# Altium schematic sheet ZYNQ_US_SOC_PS_PSIO.SchDoc
size 420 x 297 mm
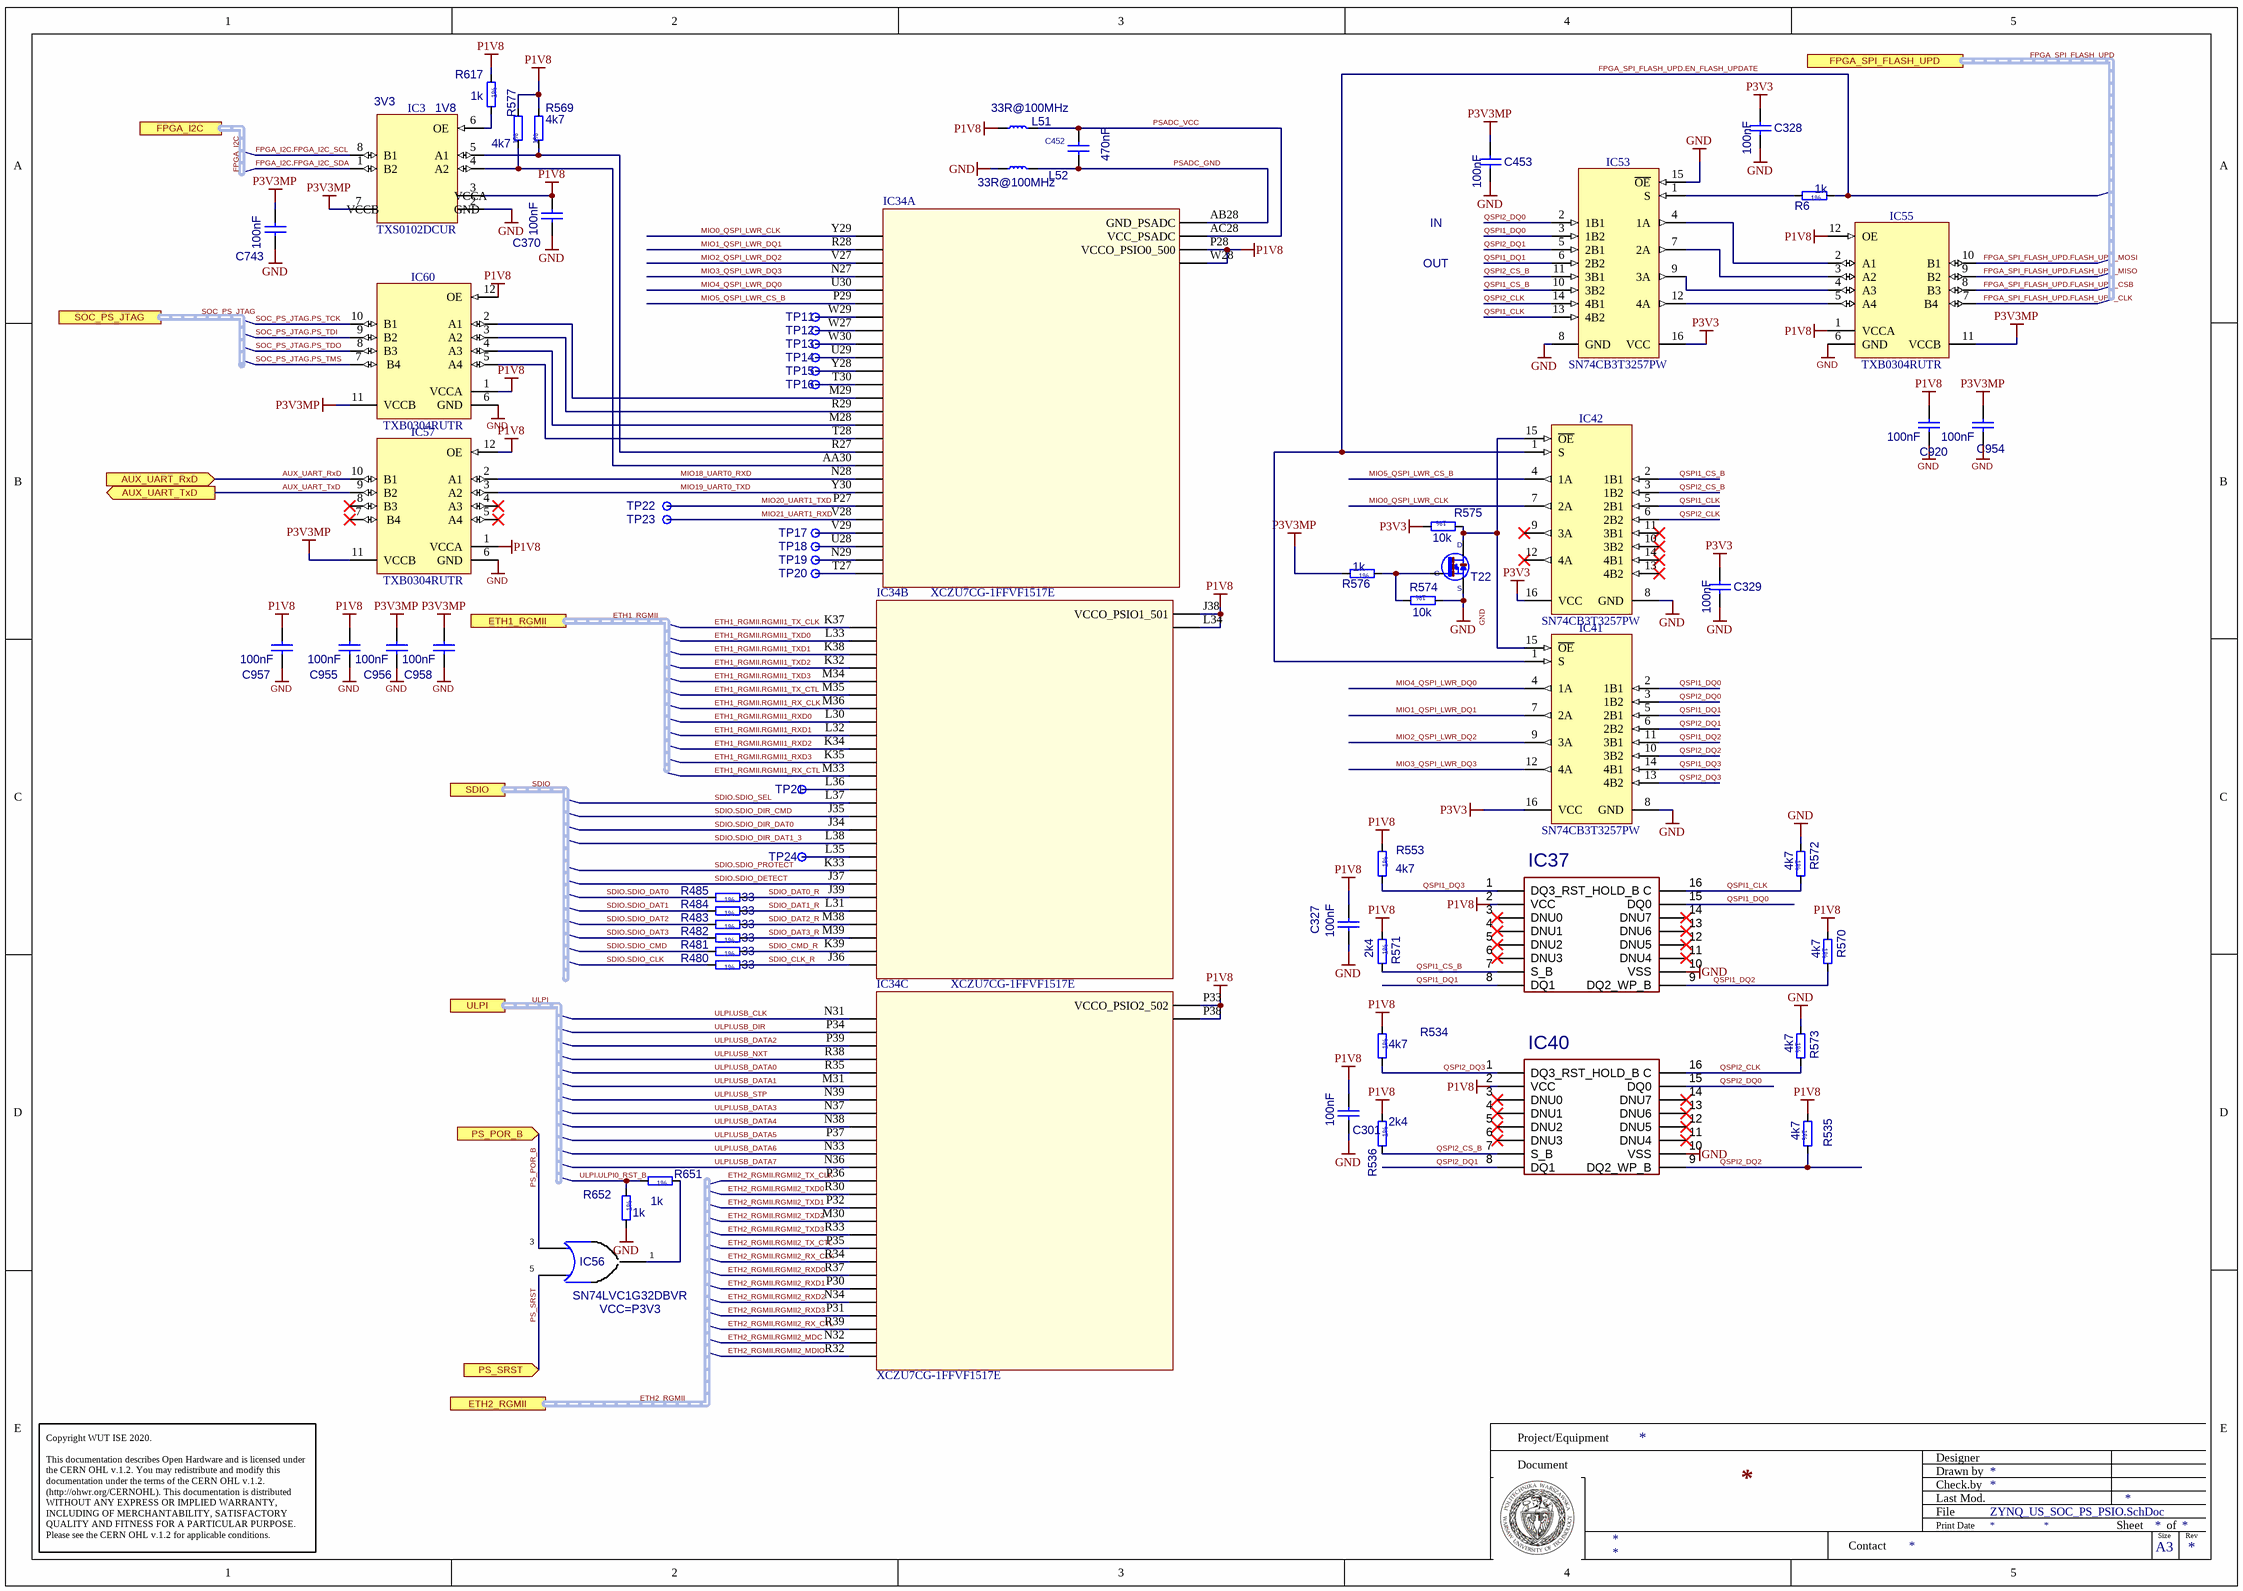
[diagram p0: ZYNQ_US_SOC_PS_PSIO.SchDoc]

## Parts
C301  value 100nF  [CAPC0603X33N]  (hidden comment: Capacitor - non polarized CAPC0603X33N)
C327  value 100nF  [CAPC0603X33N]  (hidden comment: Capacitor - non polarized CAPC0603X33N)
C328  value 100nF  [CAPC0603X33N]  (hidden comment: Capacitor - non polarized CAPC0603X33N)
C329  value 100nF  [CAPC0603X33N]  (hidden comment: Capacitor - non polarized CAPC0603X33N)
C370  value 100nF  [CAPC0603X33N]  (hidden comment: Capacitor - non polarized CAPC0603X33N)
C452  value 470nF  [CAPC0603X33N]  (hidden comment: Capacitor - non polarized CAPC0603X33N)
C453  value 100nF  [CAPC0603X33N]  (hidden comment: Capacitor - non polarized CAPC0603X33N)
C743  value 100nF  [CAPC0603X33N]  (hidden comment: Capacitor - non polarized CAPC0603X33N)
C920  value 100nF  [CAPC0603X33N]  (hidden comment: Capacitor - non polarized CAPC0603X33N)
C954  value 100nF  [CAPC0603X33N]  (hidden comment: Capacitor - non polarized CAPC0603X33N)
C955  value 100nF  [CAPC0603X33N]  (hidden comment: Capacitor - non polarized CAPC0603X33N)
C956  value 100nF  [CAPC0603X33N]  (hidden comment: Capacitor - non polarized CAPC0603X33N)
C957  value 100nF  [CAPC0603X33N]  (hidden comment: Capacitor - non polarized CAPC0603X33N)
C958  value 100nF  [CAPC0603X33N]  (hidden comment: Capacitor - non polarized CAPC0603X33N)
IC3  TXS0102DCUR  [SOP50P310X90-8N]
IC34  XCZU7CG-1FFVF1517E  (parts A,B,C of 26)
IC37  MT25QU512ABB8ESF-0SIT  [SOIC127P1032X265-16N]  (value not drawn)
IC40  MT25QU512ABB8ESF-0SIT  [SOIC127P1032X265-16N]  (value not drawn)
IC41  SN74CB3T3257PW  [SOP65P640X120-16N]
IC42  SN74CB3T3257PW  [SOP65P640X120-16N]
IC53  SN74CB3T3257PW  [SOP65P640X120-16N]
IC55  TXB0304RUTR  [TEXAS_RUT (R-PUQFN-N12)]
IC56  Supply Rename: VCC=P3V3  [SOT95P280X145-5N]  (hidden comment: SN74LVC1G32DBVR)
IC57  TXB0304RUTR  [TEXAS_RUT (R-PUQFN-N12)]
IC60  TXB0304RUTR  [TEXAS_RUT (R-PUQFN-N12)]
L51  value 33R@100MHz  [INDC1005X55N]  (hidden comment: IND0402_MURATA_BLM15PX330SN1D)
L52  value 33R@100MHz  [INDC1005X55N]  (hidden comment: IND0402_MURATA_BLM15PX330SN1D)
R6  value 1k  (hidden comment: Resistor - 1% RESC1005X40N)
R480  value 33  (hidden comment: Resistor - 1% RESC1005X40N)
R481  value 33  (hidden comment: Resistor - 1% RESC1005X40N)
R482  value 33  (hidden comment: Resistor - 1% RESC1005X40N)
R483  value 33  (hidden comment: Resistor - 1% RESC1005X40N)
R484  value 33  (hidden comment: Resistor - 1% RESC1005X40N)
R485  value 33  (hidden comment: Resistor - 1% RESC1005X40N)
R534  value 4k7  (hidden comment: Resistor - 1% RESC1005X40N)
R535  value 4k7  (hidden comment: Resistor - 1% RESC1005X40N)
R536  value 2k4  (hidden comment: Resistor - 1% RESC1005X40N)
R553  value 4k7  (hidden comment: Resistor - 1% RESC1005X40N)
R569  value 4k7  (hidden comment: Resistor - 1% RESC1005X40N)
R570  value 4k7  (hidden comment: Resistor - 1% RESC1005X40N)
R571  value 2k4  (hidden comment: Resistor - 1% RESC1005X40N)
R572  value 4k7  (hidden comment: Resistor - 1% RESC1005X40N)
R573  value 4k7  (hidden comment: Resistor - 1% RESC1005X40N)
R574  value 10k  (hidden comment: Resistor - 1% RESC1005X40N)
R575  value 10k  (hidden comment: Resistor - 1% RESC1005X40N)
R576  value 1k  (hidden comment: Resistor - 1% RESC1005X40N)
R577  value 4k7  (hidden comment: Resistor - 1% RESC1005X40N)
R617  value 1k  (hidden comment: Resistor - 1% RESC1005X40N)
R651  value 1k  (hidden comment: Resistor - 1% RESC1005X40N)
R652  value 1k  (hidden comment: Resistor - 1% RESC1005X40N)
T22  BSS138LT1G  [SOT95P240X110-3N]  (value not drawn)
TP11  SMD_PAD_D1MM  [C100]  (value not drawn)
TP12  SMD_PAD_D1MM  [C100]  (value not drawn)
TP13  SMD_PAD_D1MM  [C100]  (value not drawn)
TP14  SMD_PAD_D1MM  [C100]  (value not drawn)
TP15  SMD_PAD_D1MM  [C100]  (value not drawn)
TP16  SMD_PAD_D1MM  [C100]  (value not drawn)
TP17  SMD_PAD_D1MM  [C100]  (value not drawn)
TP18  SMD_PAD_D1MM  [C100]  (value not drawn)
TP19  SMD_PAD_D1MM  [C100]  (value not drawn)
TP20  SMD_PAD_D1MM  [C100]  (value not drawn)
TP21  SMD_PAD_D1MM  [C100]  (value not drawn)
TP22  SMD_PAD_D1MM  [C100]  (value not drawn)
TP23  SMD_PAD_D1MM  [C100]  (value not drawn)
TP24  SMD_PAD_D1MM  [C100]  (value not drawn)

## Ports
AUX_UART_RxD (in), AUX_UART_TxD (out), ETH1_RGMII (harness ETH1_RGMII), ETH2_RGMII (harness ETH2_RGMII), FPGA_I2C (harness FPGA_I2C), FPGA_SPI_FLASH_UPD (harness FPGA_SPI_FLASH_UPD), PS_POR_B (in), PS_SRST (in), SDIO (harness SDIO), SOC_PS_JTAG (harness SOC_PS_JTAG), ULPI (harness ULPI)

## Nets
GND: C301.1 C327.1 C328.1 C329.1 C370.1 C453.1 C743.1 C920.1 C954.1 C955.1 C956.1 C957.1 C958.1 IC3.2(GND) IC37.10(VSS) IC40.10(VSS) IC41.8(GND) IC42.8(GND) IC53.8(GND) IC53.15(~{OE}) IC55.6(GND) IC57.6(GND) IC60.6(GND) L52.1 R572.1 R573.1 R574.1 R652.1 T22.2(S)
P1V8: C301.2 C327.2 C370.2 C920.2 C955.2 C957.2 IC3.3(Vcca) IC34.J38(VCCO_PSIO1_501) IC34.L34(VCCO_PSIO1_501_1) IC34.P28(VCCO_PSIO0_500) IC34.P33(VCCO_PSIO2_502) IC34.P38(VCCO_PSIO2_502_1) IC34.W28(VCCO_PSIO0_500_1) IC37.2(VCC) IC40.2(VCC) IC55.1(VCCA) IC55.12(OE) IC57.1(VCCA) IC57.12(OE) IC60.1(VCCA) IC60.12(OE) L51.1 R534.2 R535.1 R536.2 R553.2 R569.2 R570.1 R571.2 R577.2 R617.2
P3V3: C328.2 C329.2 IC41.16(VCC) IC42.16(VCC) IC53.16(VCC) IC56.2(VCC) R575.2
P3V3MP: C453.2 C743.2 C954.2 C956.2 C958.2 IC3.7(Vccb) IC55.11(VCCB) IC57.11(VCCB) IC60.11(VCCB) R576.1
AUX_UART_RxD: IC57.10(B1) ; port AUX_UART_RxD
AUX_UART_TxD: IC57.9(B2) ; port AUX_UART_TxD
ETH1_RGMII.RGMII1_RX_CLK: IC34.M36(PS8_X0Y0_23)
ETH1_RGMII.RGMII1_RX_CTL: IC34.M33(PS8_X0Y0_20)
ETH1_RGMII.RGMII1_RXD0: IC34.L30(PS8_X0Y0_12)
ETH1_RGMII.RGMII1_RXD1: IC34.L32(PS8_X0Y0_14)
ETH1_RGMII.RGMII1_RXD2: IC34.K34(PS8_X0Y0_7)
ETH1_RGMII.RGMII1_RXD3: IC34.K35(PS8_X0Y0_8)
ETH1_RGMII.RGMII1_TX_CLK: IC34.K37(PS8_X0Y0_9)
ETH1_RGMII.RGMII1_TX_CTL: IC34.M35(PS8_X0Y0_22)
ETH1_RGMII.RGMII1_TXD0: IC34.L33(PS8_X0Y0_15)
ETH1_RGMII.RGMII1_TXD1: IC34.K38(PS8_X0Y0_10)
ETH1_RGMII.RGMII1_TXD2: IC34.K32(PS8_X0Y0_5)
ETH1_RGMII.RGMII1_TXD3: IC34.M34(PS8_X0Y0_21)
ETH2_RGMII.RGMII2_MDC: IC34.N32(PS8_X0Y0_3)
ETH2_RGMII.RGMII2_MDIO: IC34.R32(PS8_X0Y0_19)
ETH2_RGMII.RGMII2_RX_CLK: IC34.R34(PS8_X0Y0_21)
ETH2_RGMII.RGMII2_RX_CTL: IC34.R39(PS8_X0Y0_25)
ETH2_RGMII.RGMII2_RXD0: IC34.R37(PS8_X0Y0_23)
ETH2_RGMII.RGMII2_RXD1: IC34.P30(PS8_X0Y0_10)
ETH2_RGMII.RGMII2_RXD2: IC34.N34(PS8_X0Y0_5)
ETH2_RGMII.RGMII2_RXD3: IC34.P31(PS8_X0Y0_11)
ETH2_RGMII.RGMII2_TX_CLK: IC34.P36(PS8_X0Y0_15)
ETH2_RGMII.RGMII2_TX_CTL: IC34.P35(PS8_X0Y0_14)
ETH2_RGMII.RGMII2_TXD0: IC34.R30(PS8_X0Y0_18)
ETH2_RGMII.RGMII2_TXD1: IC34.P32(PS8_X0Y0_12)
ETH2_RGMII.RGMII2_TXD2: IC34.M30(PS8_X0Y0)
ETH2_RGMII.RGMII2_TXD3: IC34.R33(PS8_X0Y0_20)
FPGA_I2C.FPGA_I2C_SCL: IC3.8(B1)
FPGA_I2C.FPGA_I2C_SDA: IC3.1(B2)
FPGA_SPI_FLASH_UPD.EN_FLASH_UPDATE: IC41.1(S) IC42.1(S) R6.2
FPGA_SPI_FLASH_UPD.FLASH_UPD_CLK: IC55.7(B4)
FPGA_SPI_FLASH_UPD.FLASH_UPD_CSB: IC55.8(B3)
FPGA_SPI_FLASH_UPD.FLASH_UPD_MISO: IC55.9(B2)
FPGA_SPI_FLASH_UPD.FLASH_UPD_MOSI: IC55.10(B1)
MIO0_QSPI_LWR_CLK: IC34.Y29(PS8_X0Y0_24) IC42.7(2A)
MIO1_QSPI_LWR_DQ1: IC34.R28(PS8_X0Y0_9) IC41.7(2A)
MIO2_QSPI_LWR_DQ2: IC34.V27(PS8_X0Y0_17) IC41.9(3A)
MIO3_QSPI_LWR_DQ3: IC34.N27(PS8_X0Y0_3) IC41.12(4A)
MIO4_QSPI_LWR_DQ0: IC34.U30(PS8_X0Y0_16) IC41.4(1A)
MIO5_QSPI_LWR_CS_B: IC34.P29(PS8_X0Y0_7) IC42.4(1A)
MIO18_UART0_RXD: IC34.N28(PS8_X0Y0_4) IC57.2(A1)
MIO19_UART0_TXD: IC34.Y30(PS8_X0Y0_25) IC57.3(A2)
MIO20_UART1_TXD: IC34.P27(PS8_X0Y0_6) TP22.1
MIO21_UART1_RXD: IC34.V28(PS8_X0Y0_18) TP23.1
PS_POR_B: IC56.3(A) ; port PS_POR_B
PS_SRST: IC56.5(B) ; port PS_SRST
PSADC_GND: C452.1 IC34.AB28(GND_PSADC) L52.2
PSADC_VCC: C452.2 IC34.AC28(VCC_PSADC) L51.2
QSPI1_CLK: IC37.16(C) IC42.5(2B1) IC53.13(4B2) R572.2
QSPI1_CS_B: IC37.7(S_B) IC42.2(1B1) IC53.10(3B2) R571.1
QSPI1_DQ0: IC37.15(DQ0) IC41.2(1B1) IC53.3(1B2)
QSPI1_DQ1: IC37.8(DQ1) IC41.5(2B1) IC53.6(2B2)
QSPI1_DQ2: IC37.9(DQ2_WP_B) IC41.11(3B1) R570.2
QSPI1_DQ3: IC37.1(DQ3_RST_HOLD_B) IC41.14(4B1) R553.1
QSPI2_CLK: IC40.16(C) IC42.6(2B2) IC53.14(4B1) R573.2
QSPI2_CS_B: IC40.7(S_B) IC42.3(1B2) IC53.11(3B1) R536.1
QSPI2_DQ0: IC40.15(DQ0) IC41.3(1B2) IC53.2(1B1)
QSPI2_DQ1: IC40.8(DQ1) IC41.6(2B2) IC53.5(2B1)
QSPI2_DQ2: IC40.9(DQ2_WP_B) IC41.10(3B2) R535.2
QSPI2_DQ3: IC40.1(DQ3_RST_HOLD_B) IC41.13(4B2) R534.1
SDIO.SDIO_CLK: R480.1
SDIO.SDIO_CMD: R481.1
SDIO.SDIO_DAT0: R485.1
SDIO.SDIO_DAT1: R484.1
SDIO.SDIO_DAT2: R483.1
SDIO.SDIO_DAT3: R482.1
SDIO.SDIO_DETECT: IC34.J37(PS8_X0Y0_3)
SDIO.SDIO_DIR_CMD: IC34.J35(PS8_X0Y0_1)
SDIO.SDIO_DIR_DAT0: IC34.J34(PS8_X0Y0)
SDIO.SDIO_DIR_DAT1_3: IC34.L38(PS8_X0Y0_19)
SDIO.SDIO_PROTECT: IC34.K33(PS8_X0Y0_6)
SDIO.SDIO_SEL: IC34.L37(PS8_X0Y0_18)
SDIO_CLK_R: IC34.J36(PS8_X0Y0_2) R480.2
SDIO_CMD_R: IC34.K39(PS8_X0Y0_11) R481.2
SDIO_DAT0_R: IC34.J39(PS8_X0Y0_4) R485.2
SDIO_DAT1_R: IC34.L31(PS8_X0Y0_13) R484.2
SDIO_DAT2_R: IC34.M38(PS8_X0Y0_24) R483.2
SDIO_DAT3_R: IC34.M39(PS8_X0Y0_25) R482.2
SOC_PS_JTAG.PS_TCK: IC60.10(B1)
SOC_PS_JTAG.PS_TDI: IC60.9(B2)
SOC_PS_JTAG.PS_TDO: IC60.8(B3)
SOC_PS_JTAG.PS_TMS: IC60.7(B4)
ULPI.ULPI0_RST_B: R651.1 R652.2
ULPI.USB_CLK: IC34.N31(PS8_X0Y0_2)
ULPI.USB_DATA0: IC34.R35(PS8_X0Y0_22)
ULPI.USB_DATA1: IC34.M31(PS8_X0Y0_1)
ULPI.USB_DATA2: IC34.P39(PS8_X0Y0_17)
ULPI.USB_DATA3: IC34.N37(PS8_X0Y0_7)
ULPI.USB_DATA4: IC34.N38(PS8_X0Y0_8)
ULPI.USB_DATA5: IC34.P37(PS8_X0Y0_16)
ULPI.USB_DATA6: IC34.N33(PS8_X0Y0_4)
ULPI.USB_DATA7: IC34.N36(PS8_X0Y0_6)
ULPI.USB_DIR: IC34.P34(PS8_X0Y0_13)
ULPI.USB_NXT: IC34.R38(PS8_X0Y0_24)
ULPI.USB_STP: IC34.N39(PS8_X0Y0_9)
NetIC3_4: IC3.4(A2) IC34.AA30(PS8_X0Y0) R577.1
NetIC3_5: IC3.5(A1) IC34.R27(PS8_X0Y0_8) R569.1
NetIC3_6: IC3.6(OE) R617.1
NetIC34_L35: IC34.L35(PS8_X0Y0_16) TP24.1
NetIC34_L36: IC34.L36(PS8_X0Y0_17) TP21.1
NetIC34_M28: IC34.M28(PS8_X0Y0_1) IC60.4(A3)
NetIC34_M29: IC34.M29(PS8_X0Y0_2) IC60.2(A1)
NetIC34_N29: IC34.N29(PS8_X0Y0_5) TP19.1
NetIC34_R29: IC34.R29(PS8_X0Y0_10) IC60.3(A2)
NetIC34_T27: IC34.T27(PS8_X0Y0_11) TP20.1
NetIC34_T28: IC34.T28(PS8_X0Y0_12) IC60.5(A4)
NetIC34_T30: IC34.T30(PS8_X0Y0_13) TP16.1
NetIC34_U28: IC34.U28(PS8_X0Y0_14) TP18.1
NetIC34_U29: IC34.U29(PS8_X0Y0_15) TP14.1
NetIC34_V29: IC34.V29(PS8_X0Y0_19) TP17.1
NetIC34_W27: IC34.W27(PS8_X0Y0_20) TP12.1
NetIC34_W29: IC34.W29(PS8_X0Y0_21) TP11.1
NetIC34_W30: IC34.W30(PS8_X0Y0_22) TP13.1
NetIC34_Y28: IC34.Y28(PS8_X0Y0_23) TP15.1
NetIC41_15: IC41.15(~{OE}) IC42.15(~{OE}) R575.1 T22.3(D)
NetIC53_1: IC53.1(S) R6.1
NetIC53_4: IC53.4(1A) IC55.2(A1)
NetIC53_7: IC53.7(2A) IC55.3(A2)
NetIC53_9: IC53.9(3A) IC55.4(A3)
NetIC53_12: IC53.12(4A) IC55.5(A4)
NetIC56_1: IC56.1(Y) R651.2
NetR574_2: R574.2 R576.2 T22.1(G)

Not connected (* = marked no-connect by the designer): IC37 3(DNU0)* 4(DNU1)* 5(DNU2)* 6(DNU3)* 11(DNU4)* 12(DNU5)* 13(DNU6)* 14(DNU7)*; IC40 3(DNU0)* 4(DNU1)* 5(DNU2)* 6(DNU3)* 11(DNU4)* 12(DNU5)* 13(DNU6)* 14(DNU7)*; IC42 9(3A)* 10(3B2)* 11(3B1)* 12(4A)* 13(4B2)* 14(4B1)*; IC57 4(A3)* 5(A4)* 7(B4)* 8(B3)*

## Buses and harness runs
harness ETH1_RGMII = port ETH1_RGMII
harness ETH2_RGMII = port ETH2_RGMII
harness FPGA_I2C = port FPGA_I2C
harness FPGA_SPI_FLASH_UPD = port FPGA_SPI_FLASH_UPD
harness SDIO = port SDIO
harness SOC_PS_JTAG = port SOC_PS_JTAG
harness ULPI = port ULPI

## Notes on the sheet
- (near IC3) 3V3
- (near IC3) 1V8
- OUT
- IN
- Labels drawn without touching a wire or pin: GND
- Project/Equipment
- Document
- Designer
- Drawn by
- Check.by
- Copyright WUT ISE 2020.
  This documentation describes Open Hardware and is licensed under the CERN OHL v.1.2. You may redistribute and modify this documentation under the terms of the CERN OHL v.1.2. (http://ohwr.org/CERNOHL). This documentation is distributed WITHOUT ANY EXPRESS OR IMPLIED WARRANTY, INCLUDING OF MERCHANTABILITY, SATISFACTORY QUALITY AND FITNESS FOR A PARTICULAR PURPOSE. Please see the CERN OHL v.1.2 for applicable conditions.
- Contact
- File
- Last Mod.
- Print Date
- Sheet
- Size
- A3
- of
- Rev
- (in symbol R6) 1%
- (in symbol R480) 1%
- (in symbol R481) 1%
- (in symbol R482) 1%
- (in symbol R483) 1%
- (in symbol R484) 1%
- (in symbol R485) 1%
- (in symbol R534) 1%
- (in symbol R535) 1%
- (in symbol R536) 1%
- (in symbol R553) 1%
- (in symbol R569) 1%
- (in symbol R570) 1%
- (in symbol R571) 1%
- (in symbol R572) 1%
- (in symbol R573) 1%
- (in symbol R574) 1%
- (in symbol R575) 1%
- (in symbol R576) 1%
- (in symbol R577) 1%
- (in symbol R617) 1%
- (in symbol R651) 1%
- (in symbol R652) 1%
- (in symbol TXS0102DCUR) VCCA; VCCB

## Library data of the parts
C301 = CAPC0603X33N: Capacitor - non polarized CAPC0603X33N 100nF; Manufacturer Part Number: CC0201_100NF_6.3V_10%_X5R; Manufacturer: GENERIC; Part Description: SMD Multilayer Chip Ceramic Capacitor; CmpIndex: 275; DXDB_LIBNAME: Capacitors SMD; Ref Designator: C301; SymIndex: 331; Tolerance: ±10%; Cell Name: CAPC0603X33N; Part Name: Capacitor - non polarized CAPC0603X33N; Part Number: Capacitor - non polarized CAPC0603X33N; Orientation: 7 = 7
C327 = CAPC0603X33N: Capacitor - non polarized CAPC0603X33N 100nF; Manufacturer Part Number: CC0201_100NF_6.3V_10%_X5R; Manufacturer: GENERIC; Part Description: SMD Multilayer Chip Ceramic Capacitor; CmpIndex: 241; DXDB_LIBNAME: Capacitors SMD; Ref Designator: C327; SymIndex: 331; Tolerance: ±10%; Cell Name: CAPC0603X33N; Part Name: Capacitor - non polarized CAPC0603X33N; Part Number: Capacitor - non polarized CAPC0603X33N; Orientation: 7 = 7
C328 = CAPC0603X33N: Capacitor - non polarized CAPC0603X33N 100nF; Manufacturer Part Number: CC0201_100NF_6.3V_10%_X5R; Manufacturer: GENERIC; Part Description: SMD Multilayer Chip Ceramic Capacitor; CmpIndex: 298; DXDB_LIBNAME: Capacitors SMD; Ref Designator: C328; SymIndex: 331; Tolerance: ±10%; Cell Name: CAPC0603X33N; Part Name: Capacitor - non polarized CAPC0603X33N; Part Number: Capacitor - non polarized CAPC0603X33N; Orientation: 1 = 1
C329 = CAPC0603X33N: Capacitor - non polarized CAPC0603X33N 100nF; Manufacturer Part Number: CC0201_100NF_6.3V_10%_X5R; Manufacturer: GENERIC; Part Description: SMD Multilayer Chip Ceramic Capacitor; CmpIndex: 302; DXDB_LIBNAME: Capacitors SMD; Ref Designator: C329; SymIndex: 331; Tolerance: ±10%; Cell Name: CAPC0603X33N; Part Name: Capacitor - non polarized CAPC0603X33N; Part Number: Capacitor - non polarized CAPC0603X33N; Orientation: 1 = 1
C370 = CAPC0603X33N: Capacitor - non polarized CAPC0603X33N 100nF; Manufacturer Part Number: CC0201_100NF_6.3V_10%_X5R; Manufacturer: GENERIC; Part Description: SMD Multilayer Chip Ceramic Capacitor; CmpIndex: 364; DXDB_LIBNAME: Capacitors SMD; Ref Designator: C370; SymIndex: 331; Tolerance: ±10%; Cell Name: CAPC0603X33N; Part Name: Capacitor - non polarized CAPC0603X33N; Part Number: Capacitor - non polarized CAPC0603X33N; Orientation: 7 = 7
C452 = CAPC0603X33N: Capacitor - non polarized CAPC0603X33N 470nF; Manufacturer Part Number: CC0201_470NF_4V_20%_X5R; Manufacturer: GENERIC; Part Description: SMD Multilayer Chip Ceramic Capacitor; CmpIndex: 192; DXDB_LIBNAME: Capacitors SMD; Ref Designator: C452; SymIndex: 331; Tolerance: ±20%; Cell Name: CAPC0603X33N; Part Name: Capacitor - non polarized CAPC0603X33N; Part Number: Capacitor - non polarized CAPC0603X33N; Orientation: 7 = 7
C453 = CAPC0603X33N: Capacitor - non polarized CAPC0603X33N 100nF; Manufacturer Part Number: CC0201_100NF_6.3V_10%_X5R; Manufacturer: GENERIC; Part Description: SMD Multilayer Chip Ceramic Capacitor; CmpIndex: 250; DXDB_LIBNAME: Capacitors SMD; Ref Designator: C453; SymIndex: 331; Tolerance: ±10%; Cell Name: CAPC0603X33N; Part Name: Capacitor - non polarized CAPC0603X33N; Part Number: Capacitor - non polarized CAPC0603X33N; Orientation: 1 = 1
C743 = CAPC0603X33N: Capacitor - non polarized CAPC0603X33N 100nF; Manufacturer Part Number: CC0201_100NF_6.3V_10%_X5R; Manufacturer: GENERIC; Part Description: SMD Multilayer Chip Ceramic Capacitor; CmpIndex: 366; DXDB_LIBNAME: Capacitors SMD; Ref Designator: C743; SymIndex: 331; Tolerance: ±10%; Cell Name: CAPC0603X33N; Part Name: Capacitor - non polarized CAPC0603X33N; Part Number: Capacitor - non polarized CAPC0603X33N; Orientation: 7 = 7
C920 = CAPC0603X33N: Capacitor - non polarized CAPC0603X33N 100nF; Manufacturer Part Number: CC0201_100NF_6.3V_10%_X5R; Manufacturer: GENERIC; Part Description: SMD Multilayer Chip Ceramic Capacitor; CmpIndex: 316; DXDB_LIBNAME: Capacitors SMD; Ref Designator: C920; SymIndex: 331; Tolerance: ±10%; Cell Name: CAPC0603X33N; Part Name: Capacitor - non polarized CAPC0603X33N; Part Number: Capacitor - non polarized CAPC0603X33N; Orientation: 1 = 1
C954 = CAPC0603X33N: Capacitor - non polarized CAPC0603X33N 100nF; Manufacturer Part Number: CC0201_100NF_6.3V_10%_X5R; Manufacturer: GENERIC; Part Description: SMD Multilayer Chip Ceramic Capacitor; CmpIndex: 319; DXDB_LIBNAME: Capacitors SMD; Ref Designator: C954; SymIndex: 331; Tolerance: ±10%; Cell Name: CAPC0603X33N; Part Name: Capacitor - non polarized CAPC0603X33N; Part Number: Capacitor - non polarized CAPC0603X33N; Orientation: 1 = 1
C955 = CAPC0603X33N: Capacitor - non polarized CAPC0603X33N 100nF; Manufacturer Part Number: CC0201_100NF_6.3V_10%_X5R; Manufacturer: GENERIC; Part Description: SMD Multilayer Chip Ceramic Capacitor; CmpIndex: 331; DXDB_LIBNAME: Capacitors SMD; Ref Designator: C955; Tolerance: ±10%; Cell Name: CAPC0603X33N; Part Name: Capacitor - non polarized CAPC0603X33N; Part Number: Capacitor - non polarized CAPC0603X33N; SymIndex: 331; Orientation: 1 = 1
C956 = CAPC0603X33N: Capacitor - non polarized CAPC0603X33N 100nF; Manufacturer Part Number: CC0201_100NF_6.3V_10%_X5R; Manufacturer: GENERIC; Part Description: SMD Multilayer Chip Ceramic Capacitor; CmpIndex: 329; DXDB_LIBNAME: Capacitors SMD; Ref Designator: C956; SymIndex: 331; Tolerance: ±10%; Cell Name: CAPC0603X33N; Part Name: Capacitor - non polarized CAPC0603X33N; Part Number: Capacitor - non polarized CAPC0603X33N; Orientation: 1 = 1
C957 = CAPC0603X33N: Capacitor - non polarized CAPC0603X33N 100nF; Manufacturer Part Number: CC0201_100NF_6.3V_10%_X5R; Manufacturer: GENERIC; Part Description: SMD Multilayer Chip Ceramic Capacitor; CmpIndex: 336; DXDB_LIBNAME: Capacitors SMD; Ref Designator: C957; SymIndex: 331; Tolerance: ±10%; Cell Name: CAPC0603X33N; Part Name: Capacitor - non polarized CAPC0603X33N; Part Number: Capacitor - non polarized CAPC0603X33N; Orientation: 1 = 1
C958 = CAPC0603X33N: Capacitor - non polarized CAPC0603X33N 100nF; Manufacturer Part Number: CC0201_100NF_6.3V_10%_X5R; Manufacturer: GENERIC; Part Description: SMD Multilayer Chip Ceramic Capacitor; CmpIndex: 341; DXDB_LIBNAME: Capacitors SMD; Ref Designator: C958; SymIndex: 331; Tolerance: ±10%; Cell Name: CAPC0603X33N; Part Name: Capacitor - non polarized CAPC0603X33N; Part Number: Capacitor - non polarized CAPC0603X33N; Orientation: 1 = 1
IC3 = TXS0102DCUR: 2-Bit Bidirectionnal Voltage-Level Translator for Open-Drain And Push-Pull Applications; Manufacturer: TEXAS INSTRUMENTS; PressFit: No; Bonding: No; Manufacturer Part Number: TXS0102DCUR; PackageDescription: SOP, 0.50mm Pitch; 8 pin, 2.30mm W X 2.00mm L X 0.90mm H body, PC Medium Density; Part Description: 2-Bit Bidirectionnal Voltage-Level Translator for Open-Drain And Push-Pull Applications; Part Number: TXS0102DCUR; Component Kind: Standard; Component Type: Standard; Device: TXS0102DCUR; Pin Count: 8; Case: TSSOP8; Mounted: Yes; Socket: No; SMD: Yes; Sense: No; ComponentHeight: 0.9mm; Author: CERN DEM JLC; HelpURL: \\cern.ch\dfs\Applications\Altium\Datasheets\TXS0102DCUR.pdf; CreateDate: 08.07.2014; LatestRevisionDate: 08.07.2014
IC37 = SOIC127P1032X265-16N: Manufacturer: Micron; Part Description: 512MBIT, MULTI-IO SERIAL NOR FLASH W RESET, 1.8V, SO16_WIDE; PARTS: 1; CmpIndex: 401; DXDB_LIBNAME: MISC_GK; Ref Designator: IC37; SymIndex: 2105; Cell Name: SOIC127P1032X265-16N; Manufacturer Part Number: MT25QU512ABB8ESF-0SIT; Part Name: MT25QU512ABB8ESF-0SIT; Part Number: MT25QU512ABB8ESF-0SIT; Value: MT25QU512ABB8ESF; Orientation: 0 = 0
IC40 = SOIC127P1032X265-16N: Manufacturer: Micron; Part Description: 512MBIT, MULTI-IO SERIAL NOR FLASH W RESET, 1.8V, SO16_WIDE; PARTS: 1; CmpIndex: 253; DXDB_LIBNAME: MISC_GK; Ref Designator: IC40; SymIndex: 2105; Cell Name: SOIC127P1032X265-16N; Manufacturer Part Number: MT25QU512ABB8ESF-0SIT; Part Name: MT25QU512ABB8ESF-0SIT; Part Number: MT25QU512ABB8ESF-0SIT; Value: MT25QU512ABB8ESF; Orientation: 0 = 0
IC41 IC42 IC53 = SN74CB3T3257PW: 4-BIT 1-OF-2 FET Multiplexer/Demultiplexer 2.5V/3.3V Low-Voltage Bus Switch 5V Tolerant Shifter; Manufacturer: TEXAS INSTRUMENTS; PressFit: No; Bonding: No; Manufacturer Part Number: SN74CB3T3257PW; PackageDescription: SOP, 0.65mm pitch; 16 pin, 4.40mm W X 5.00mm L X 1.20mm H body IPC Medium Density; Part Description: 4-Bit 1-of-2 FET Multiplexer/Demultiplexer 2.5V/3.3V Low-Voltage Bus Switch 5V Tolerant Shifter; Part Number: SN74CB3T3257PW; Component Kind: Standard; Component Type: Standard; Device: SN74CB3T3257PW; Pin Count: 16; Case: TSSOP16; Mounted: Yes; Socket: No; SMD: Yes; Sense: No; ComponentHeight: 1.2mm; Author: CERN DEM JLC; HelpURL: \\cern.ch\dfs\Applications\Altium\Datasheets\SN74CB3T3257PW.pdf; CreateDate: 30.01.2012; LatestRevisionDate: 30.01.2012
IC55 IC57 IC60 = TXB0304RUTR: 4-bit Bidirectional Auto-direction Sensing Translator with Fully Symmetric 0.9V to 3.6V Range; Manufacturer: TEXAS INSTRUMENTS; PressFit: No; Bonding: No; Manufacturer Part Number: TXB0304RUTR; PackageDescription: SON, TEXAS RUT (R-PUQFN-N12), 0.50mm Pitch, 12-pin, 1.70mm W  X 2.00mm L X 0.55mm Height; Part Description: 4-bit Bidirectional Auto-direction Sensing Translator with Fully Symmetric 0.9V to 3.6V Range; Part Number: TXB0304RUTR; Component Kind: Standard; Component Type: Standard; Device: TXB0304RUTR; Pin Count: 12; Case: QFN12; Mounted: Yes; Socket: No; SMD: Yes; Sense: No; ComponentHeight: 0.55mm; Author: CERN DEM JLC; HelpURL: \\cern.ch\dfs\Applications\Altium\Datasheets\TXB0304RUTR.pdf; CreateDate: 27.10.2014; LatestRevisionDate: 28.10.2014
IC56 = SOT95P280X145-5N: Manufacturer: TEXAS INSTRUMENTS; Part Description: Single 2-Input Positive-OR Gate; CmpIndex: 272; DXDB_LIBNAME: IC_Standard_Logic; Ref Designator: IC56; SymIndex: 2016; Cell Name: SOT95P280X145-5N; Manufacturer Part Number: SN74LVC1G32DBVR; PackageDescription: SOT, 0.95mm pitch; 5 pin, 1.60mm W X 2.90mm L X 1.45mm H body, IPC Medium Density; Part Name: SN74LVC1G32DBVR; Part Number: SN74LVC1G32DBVR; Orientation: 0 = 0
L51 = INDC1005X55N: IND0402_MURATA_BLM15PX330SN1D   33R@100MHz; Manufacturer: MURATA; Part Description: SMD EMIFIL Chip Ferrite Bead; CmpIndex: 196; DXDB_LIBNAME: Inductors_SMD; Ref Designator: L51; SymIndex: 367; Tolerance: ±25%; Cell Name: INDC1005X55N; Manufacturer Part Number: BLM15PX330SN1D; Part Name: IND0402_MURATA_BLM15PX330SN1D; Part Number: IND0402_MURATA_BLM15PX330SN1D; Orientation: 0 = 0
L52 = INDC1005X55N: IND0402_MURATA_BLM15PX330SN1D   33R@100MHz; Manufacturer: MURATA; Part Description: SMD EMIFIL Chip Ferrite Bead; CmpIndex: 197; DXDB_LIBNAME: Inductors_SMD; Ref Designator: L52; SymIndex: 367; Tolerance: ±25%; Cell Name: INDC1005X55N; Manufacturer Part Number: BLM15PX330SN1D; Part Name: IND0402_MURATA_BLM15PX330SN1D; Part Number: IND0402_MURATA_BLM15PX330SN1D; Orientation: 0 = 0
R6 = (no symbol name): Resistor - 1% RESC1005X40N 1k; Manufacturer Part Number: R0402_1K_1%_0.0625W_100PPM; Manufacturer: GENERIC; Part Description: General Purpose Thick Film Chip Resistor; CmpIndex: 317; DXDB_LIBNAME: Resistors SMD; Ref Designator: R6; Cell Name: RESC1005X40N; Part Name: Resistor - 1% RESC1005X40N; Part Number: Resistor - 1% RESC1005X40N; SymIndex: 317; Tolerance: ±1%; Orientation: 0 = 0
R480 = (no symbol name): Resistor - 1% RESC1005X40N 33; Manufacturer Part Number: R0402_33R_1%_0.0625W_100PPM; Manufacturer: GENERIC; Part Description: General Purpose Thick Film Chip Resistor; CmpIndex: 208; DXDB_LIBNAME: Resistors SMD; Ref Designator: R480; SymIndex: 317; Cell Name: RESC1005X40N; Part Name: Resistor - 1% RESC1005X40N; Part Number: Resistor - 1% RESC1005X40N; Tolerance: ±1%; Orientation: 0 = 0
R481 = (no symbol name): Resistor - 1% RESC1005X40N 33; Manufacturer Part Number: R0402_33R_1%_0.0625W_100PPM; Manufacturer: GENERIC; Part Description: General Purpose Thick Film Chip Resistor; CmpIndex: 209; DXDB_LIBNAME: Resistors SMD; Ref Designator: R481; SymIndex: 317; Cell Name: RESC1005X40N; Part Name: Resistor - 1% RESC1005X40N; Part Number: Resistor - 1% RESC1005X40N; Tolerance: ±1%; Orientation: 0 = 0
R482 = (no symbol name): Resistor - 1% RESC1005X40N 33; Manufacturer Part Number: R0402_33R_1%_0.0625W_100PPM; Manufacturer: GENERIC; Part Description: General Purpose Thick Film Chip Resistor; CmpIndex: 210; DXDB_LIBNAME: Resistors SMD; Ref Designator: R482; SymIndex: 317; Cell Name: RESC1005X40N; Part Name: Resistor - 1% RESC1005X40N; Part Number: Resistor - 1% RESC1005X40N; Tolerance: ±1%; Orientation: 0 = 0
R483 = (no symbol name): Resistor - 1% RESC1005X40N 33; Manufacturer Part Number: R0402_33R_1%_0.0625W_100PPM; Manufacturer: GENERIC; Part Description: General Purpose Thick Film Chip Resistor; CmpIndex: 211; DXDB_LIBNAME: Resistors SMD; Ref Designator: R483; SymIndex: 317; Cell Name: RESC1005X40N; Part Name: Resistor - 1% RESC1005X40N; Part Number: Resistor - 1% RESC1005X40N; Tolerance: ±1%; Orientation: 0 = 0
R484 = (no symbol name): Resistor - 1% RESC1005X40N 33; Manufacturer Part Number: R0402_33R_1%_0.0625W_100PPM; Manufacturer: GENERIC; Part Description: General Purpose Thick Film Chip Resistor; CmpIndex: 212; DXDB_LIBNAME: Resistors SMD; Ref Designator: R484; SymIndex: 317; Cell Name: RESC1005X40N; Part Name: Resistor - 1% RESC1005X40N; Part Number: Resistor - 1% RESC1005X40N; Tolerance: ±1%; Orientation: 0 = 0
R485 = (no symbol name): Resistor - 1% RESC1005X40N 33; Manufacturer Part Number: R0402_33R_1%_0.0625W_100PPM; Manufacturer: GENERIC; Part Description: General Purpose Thick Film Chip Resistor; CmpIndex: 213; DXDB_LIBNAME: Resistors SMD; Ref Designator: R485; SymIndex: 317; Cell Name: RESC1005X40N; Part Name: Resistor - 1% RESC1005X40N; Part Number: Resistor - 1% RESC1005X40N; Tolerance: ±1%; Orientation: 0 = 0
R534 = (no symbol name): Resistor - 1% RESC1005X40N 4k7; Manufacturer Part Number: R0402_4K7_1%_0.0625W_100PPM; Manufacturer: GENERIC; Part Description: General Purpose Thick Film Chip Resistor; CmpIndex: 282; DXDB_LIBNAME: Resistors SMD; Ref Designator: R534; SymIndex: 317; Cell Name: RESC1005X40N; Part Name: Resistor - 1% RESC1005X40N; Part Number: Resistor - 1% RESC1005X40N; Tolerance: ±1%; Orientation: 1 = 1
R535 = (no symbol name): Resistor - 1% RESC1005X40N 4k7; Manufacturer Part Number: R0402_4K7_1%_0.0625W_100PPM; Manufacturer: GENERIC; Part Description: General Purpose Thick Film Chip Resistor; CmpIndex: 280; DXDB_LIBNAME: Resistors SMD; Ref Designator: R535; SymIndex: 317; Cell Name: RESC1005X40N; Part Name: Resistor - 1% RESC1005X40N; Part Number: Resistor - 1% RESC1005X40N; Tolerance: ±1%; Orientation: 3 = 3
R536 = (no symbol name): Resistor - 1% RESC1005X40N 2k4; Manufacturer Part Number: R0402_2K4_1%_0.0625W_100PPM; Manufacturer: GENERIC; Part Description: General Purpose Thick Film Chip Resistor; CmpIndex: 283; DXDB_LIBNAME: Resistors SMD; Ref Designator: R536; SymIndex: 317; Cell Name: RESC1005X40N; Part Name: Resistor - 1% RESC1005X40N; Part Number: Resistor - 1% RESC1005X40N; Tolerance: ±1%; Orientation: 1 = 1
R553 = (no symbol name): Resistor - 1% RESC1005X40N 4k7; Manufacturer Part Number: R0402_4K7_1%_0.0625W_100PPM; Manufacturer: GENERIC; Part Description: General Purpose Thick Film Chip Resistor; CmpIndex: 254; DXDB_LIBNAME: Resistors SMD; Ref Designator: R553; SymIndex: 317; Cell Name: RESC1005X40N; Part Name: Resistor - 1% RESC1005X40N; Part Number: Resistor - 1% RESC1005X40N; Tolerance: ±1%; Orientation: 1 = 1
R569 = (no symbol name): Resistor - 1% RESC1005X40N 4k7; Manufacturer Part Number: R0402_4K7_1%_0.0625W_100PPM; Manufacturer: GENERIC; Part Description: General Purpose Thick Film Chip Resistor; CmpIndex: 369; DXDB_LIBNAME: Resistors SMD; Ref Designator: R569; SymIndex: 317; Cell Name: RESC1005X40N; Part Name: Resistor - 1% RESC1005X40N; Part Number: Resistor - 1% RESC1005X40N; Tolerance: ±1%; Orientation: 7 = 7
R570 = (no symbol name): Resistor - 1% RESC1005X40N 4k7; Manufacturer Part Number: R0402_4K7_1%_0.0625W_100PPM; Manufacturer: GENERIC; Part Description: General Purpose Thick Film Chip Resistor; CmpIndex: 264; DXDB_LIBNAME: Resistors SMD; Ref Designator: R570; SymIndex: 317; Cell Name: RESC1005X40N; Part Name: Resistor - 1% RESC1005X40N; Part Number: Resistor - 1% RESC1005X40N; Tolerance: ±1%; Orientation: 3 = 3
R571 = (no symbol name): Resistor - 1% RESC1005X40N 2k4; Manufacturer Part Number: R0402_2K4_1%_0.0625W_100PPM; Manufacturer: GENERIC; Part Description: General Purpose Thick Film Chip Resistor; CmpIndex: 255; DXDB_LIBNAME: Resistors SMD; Ref Designator: R571; SymIndex: 317; Cell Name: RESC1005X40N; Part Name: Resistor - 1% RESC1005X40N; Part Number: Resistor - 1% RESC1005X40N; Tolerance: ±1%; Orientation: 1 = 1
R572 = (no symbol name): Resistor - 1% RESC1005X40N 4k7; Manufacturer Part Number: R0402_4K7_1%_0.0625W_100PPM; Manufacturer: GENERIC; Part Description: General Purpose Thick Film Chip Resistor; CmpIndex: 292; DXDB_LIBNAME: Resistors SMD; Ref Designator: R572; SymIndex: 317; Cell Name: RESC1005X40N; Part Name: Resistor - 1% RESC1005X40N; Part Number: Resistor - 1% RESC1005X40N; Tolerance: ±1%; Orientation: 3 = 3
R573 = (no symbol name): Resistor - 1% RESC1005X40N 4k7; Manufacturer Part Number: R0402_4K7_1%_0.0625W_100PPM; Manufacturer: GENERIC; Part Description: General Purpose Thick Film Chip Resistor; CmpIndex: 294; DXDB_LIBNAME: Resistors SMD; Ref Designator: R573; SymIndex: 317; Cell Name: RESC1005X40N; Part Name: Resistor - 1% RESC1005X40N; Part Number: Resistor - 1% RESC1005X40N; Tolerance: ±1%; Orientation: 3 = 3
R574 = (no symbol name): Resistor - 1% RESC1005X40N 10k; Manufacturer Part Number: R0402_10K_1%_0.0625W_100PPM; Manufacturer: GENERIC; Part Description: General Purpose Thick Film Chip Resistor; CmpIndex: 246; DXDB_LIBNAME: Resistors SMD; Ref Designator: R574; SymIndex: 317; Cell Name: RESC1005X40N; Part Name: Resistor - 1% RESC1005X40N; Part Number: Resistor - 1% RESC1005X40N; Tolerance: ±1%; Orientation: 2 = 2
R575 = (no symbol name): Resistor - 1% RESC1005X40N 10k; Manufacturer Part Number: R0402_10K_1%_0.0625W_100PPM; Manufacturer: GENERIC; Part Description: General Purpose Thick Film Chip Resistor; CmpIndex: 249; DXDB_LIBNAME: Resistors SMD; Ref Designator: R575; SymIndex: 317; Cell Name: RESC1005X40N; Part Name: Resistor - 1% RESC1005X40N; Part Number: Resistor - 1% RESC1005X40N; Tolerance: ±1%; Orientation: 2 = 2
R576 = (no symbol name): Resistor - 1% RESC1005X40N 1k; Manufacturer Part Number: R0402_1K_1%_0.0625W_100PPM; Manufacturer: GENERIC; Part Description: General Purpose Thick Film Chip Resistor; CmpIndex: 307; DXDB_LIBNAME: Resistors SMD; Ref Designator: R576; SymIndex: 317; Cell Name: RESC1005X40N; Part Name: Resistor - 1% RESC1005X40N; Part Number: Resistor - 1% RESC1005X40N; Tolerance: ±1%; Orientation: 0 = 0
R577 = (no symbol name): Resistor - 1% RESC1005X40N 4k7; Manufacturer Part Number: R0402_4K7_1%_0.0625W_100PPM; Manufacturer: GENERIC; Part Description: General Purpose Thick Film Chip Resistor; CmpIndex: 370; DXDB_LIBNAME: Resistors SMD; Ref Designator: R577; SymIndex: 317; Cell Name: RESC1005X40N; Part Name: Resistor - 1% RESC1005X40N; Part Number: Resistor - 1% RESC1005X40N; Tolerance: ±1%; Orientation: 7 = 7
R617 = (no symbol name): Resistor - 1% RESC1005X40N 1k; Manufacturer Part Number: R0402_1K_1%_0.0625W_100PPM; Manufacturer: GENERIC; Part Description: General Purpose Thick Film Chip Resistor; CmpIndex: 372; DXDB_LIBNAME: Resistors SMD; Ref Designator: R617; SymIndex: 317; Cell Name: RESC1005X40N; Part Name: Resistor - 1% RESC1005X40N; Part Number: Resistor - 1% RESC1005X40N; Tolerance: ±1%; Orientation: 1 = 1
R651 = (no symbol name): Resistor - 1% RESC1005X40N 1k; Manufacturer Part Number: R0402_1K_1%_0.0625W_100PPM; Manufacturer: GENERIC; Part Description: General Purpose Thick Film Chip Resistor; CmpIndex: 232; DXDB_LIBNAME: Resistors SMD; Ref Designator: R651; SymIndex: 317; Cell Name: RESC1005X40N; Part Name: Resistor - 1% RESC1005X40N; Part Number: Resistor - 1% RESC1005X40N; Tolerance: ±1%; Orientation: 0 = 0
R652 = (no symbol name): Resistor - 1% RESC1005X40N 1k; Manufacturer Part Number: R0402_1K_1%_0.0625W_100PPM; Manufacturer: GENERIC; Part Description: General Purpose Thick Film Chip Resistor; CmpIndex: 233; DXDB_LIBNAME: Resistors SMD; Ref Designator: R652; SymIndex: 317; Cell Name: RESC1005X40N; Part Name: Resistor - 1% RESC1005X40N; Part Number: Resistor - 1% RESC1005X40N; Tolerance: ±1%; Orientation: 1 = 1
T22 = SOT95P240X110-3N: Manufacturer: ON SEMICONDUCTOR; Part Description: 50V 200mA N-Channel Enhancement Mode Field-Effect Transistor; CmpIndex: 303; DXDB_LIBNAME: Transistors; Ref Designator: T22; SymIndex: 1600; Cell Name: SOT95P240X110-3N; Manufacturer Part Number: BSS138LT1G; PackageDescription: SOT23 3-Leads, Pitch 0.95mm - Body 1.4x3mm, IPC Medium Density; Part Name: BSS138LT1G; Part Number: BSS138LT1G; Orientation: 0 = 0
TP11 = C100: Part Description: 1mm Diameter SMD Pad; Partition: Pads; CmpIndex: 220; Ref Designator: TP11; SymIndex: 2108; Cell Name: C100; PackageDescription: 1mm Diameter SMD Pad; Part Name: SMD_PAD_D1MM; Part Number: SMD_PAD_D1MM; Orientation: 0 = 0
TP12 = C100: Part Description: 1mm Diameter SMD Pad; Partition: Pads; CmpIndex: 221; Ref Designator: TP12; SymIndex: 2108; Cell Name: C100; PackageDescription: 1mm Diameter SMD Pad; Part Name: SMD_PAD_D1MM; Part Number: SMD_PAD_D1MM; Orientation: 0 = 0
TP13 = C100: Part Description: 1mm Diameter SMD Pad; Partition: Pads; CmpIndex: 222; Ref Designator: TP13; SymIndex: 2108; Cell Name: C100; PackageDescription: 1mm Diameter SMD Pad; Part Name: SMD_PAD_D1MM; Part Number: SMD_PAD_D1MM; Orientation: 0 = 0
TP14 = C100: Part Description: 1mm Diameter SMD Pad; Partition: Pads; CmpIndex: 223; Ref Designator: TP14; SymIndex: 2108; Cell Name: C100; PackageDescription: 1mm Diameter SMD Pad; Part Name: SMD_PAD_D1MM; Part Number: SMD_PAD_D1MM; Orientation: 0 = 0
TP15 = C100: Part Description: 1mm Diameter SMD Pad; Partition: Pads; CmpIndex: 224; Ref Designator: TP15; SymIndex: 2108; Cell Name: C100; PackageDescription: 1mm Diameter SMD Pad; Part Name: SMD_PAD_D1MM; Part Number: SMD_PAD_D1MM; Orientation: 0 = 0
TP16 = C100: Part Description: 1mm Diameter SMD Pad; Partition: Pads; CmpIndex: 225; Ref Designator: TP16; SymIndex: 2108; Cell Name: C100; PackageDescription: 1mm Diameter SMD Pad; Part Name: SMD_PAD_D1MM; Part Number: SMD_PAD_D1MM; Orientation: 0 = 0
TP17 = C100: Part Description: 1mm Diameter SMD Pad; Partition: Pads; CmpIndex: 226; Ref Designator: TP17; SymIndex: 2108; Cell Name: C100; PackageDescription: 1mm Diameter SMD Pad; Part Name: SMD_PAD_D1MM; Part Number: SMD_PAD_D1MM; Orientation: 0 = 0
TP18 = C100: Part Description: 1mm Diameter SMD Pad; Partition: Pads; CmpIndex: 227; Ref Designator: TP18; SymIndex: 2108; Cell Name: C100; PackageDescription: 1mm Diameter SMD Pad; Part Name: SMD_PAD_D1MM; Part Number: SMD_PAD_D1MM; Orientation: 0 = 0
TP19 = C100: Part Description: 1mm Diameter SMD Pad; Partition: Pads; CmpIndex: 228; Ref Designator: TP19; SymIndex: 2108; Cell Name: C100; PackageDescription: 1mm Diameter SMD Pad; Part Name: SMD_PAD_D1MM; Part Number: SMD_PAD_D1MM; Orientation: 0 = 0
TP20 = C100: Part Description: 1mm Diameter SMD Pad; Partition: Pads; CmpIndex: 229; Ref Designator: TP20; SymIndex: 2108; Cell Name: C100; PackageDescription: 1mm Diameter SMD Pad; Part Name: SMD_PAD_D1MM; Part Number: SMD_PAD_D1MM; Orientation: 0 = 0
TP21 = C100: Part Description: 1mm Diameter SMD Pad; Partition: Pads; CmpIndex: 230; Ref Designator: TP21; SymIndex: 2108; Cell Name: C100; PackageDescription: 1mm Diameter SMD Pad; Part Name: SMD_PAD_D1MM; Part Number: SMD_PAD_D1MM; Orientation: 0 = 0
TP22 = C100: Part Description: 1mm Diameter SMD Pad; Partition: Pads; CmpIndex: 260; Ref Designator: TP22; SymIndex: 2108; Cell Name: C100; PackageDescription: 1mm Diameter SMD Pad; Part Name: SMD_PAD_D1MM; Part Number: SMD_PAD_D1MM; Orientation: 0 = 0
TP23 = C100: Part Description: 1mm Diameter SMD Pad; Partition: Pads; CmpIndex: 265; Ref Designator: TP23; SymIndex: 2108; Cell Name: C100; PackageDescription: 1mm Diameter SMD Pad; Part Name: SMD_PAD_D1MM; Part Number: SMD_PAD_D1MM; Orientation: 0 = 0
TP24 = C100: Part Description: 1mm Diameter SMD Pad; Partition: Pads; CmpIndex: 271; Ref Designator: TP24; SymIndex: 2108; Cell Name: C100; PackageDescription: 1mm Diameter SMD Pad; Part Name: SMD_PAD_D1MM; Part Number: SMD_PAD_D1MM; Orientation: 0 = 0